# EasyEDA Pro project PR.eprj, board 新大符2.0（下单PCB） (continued)
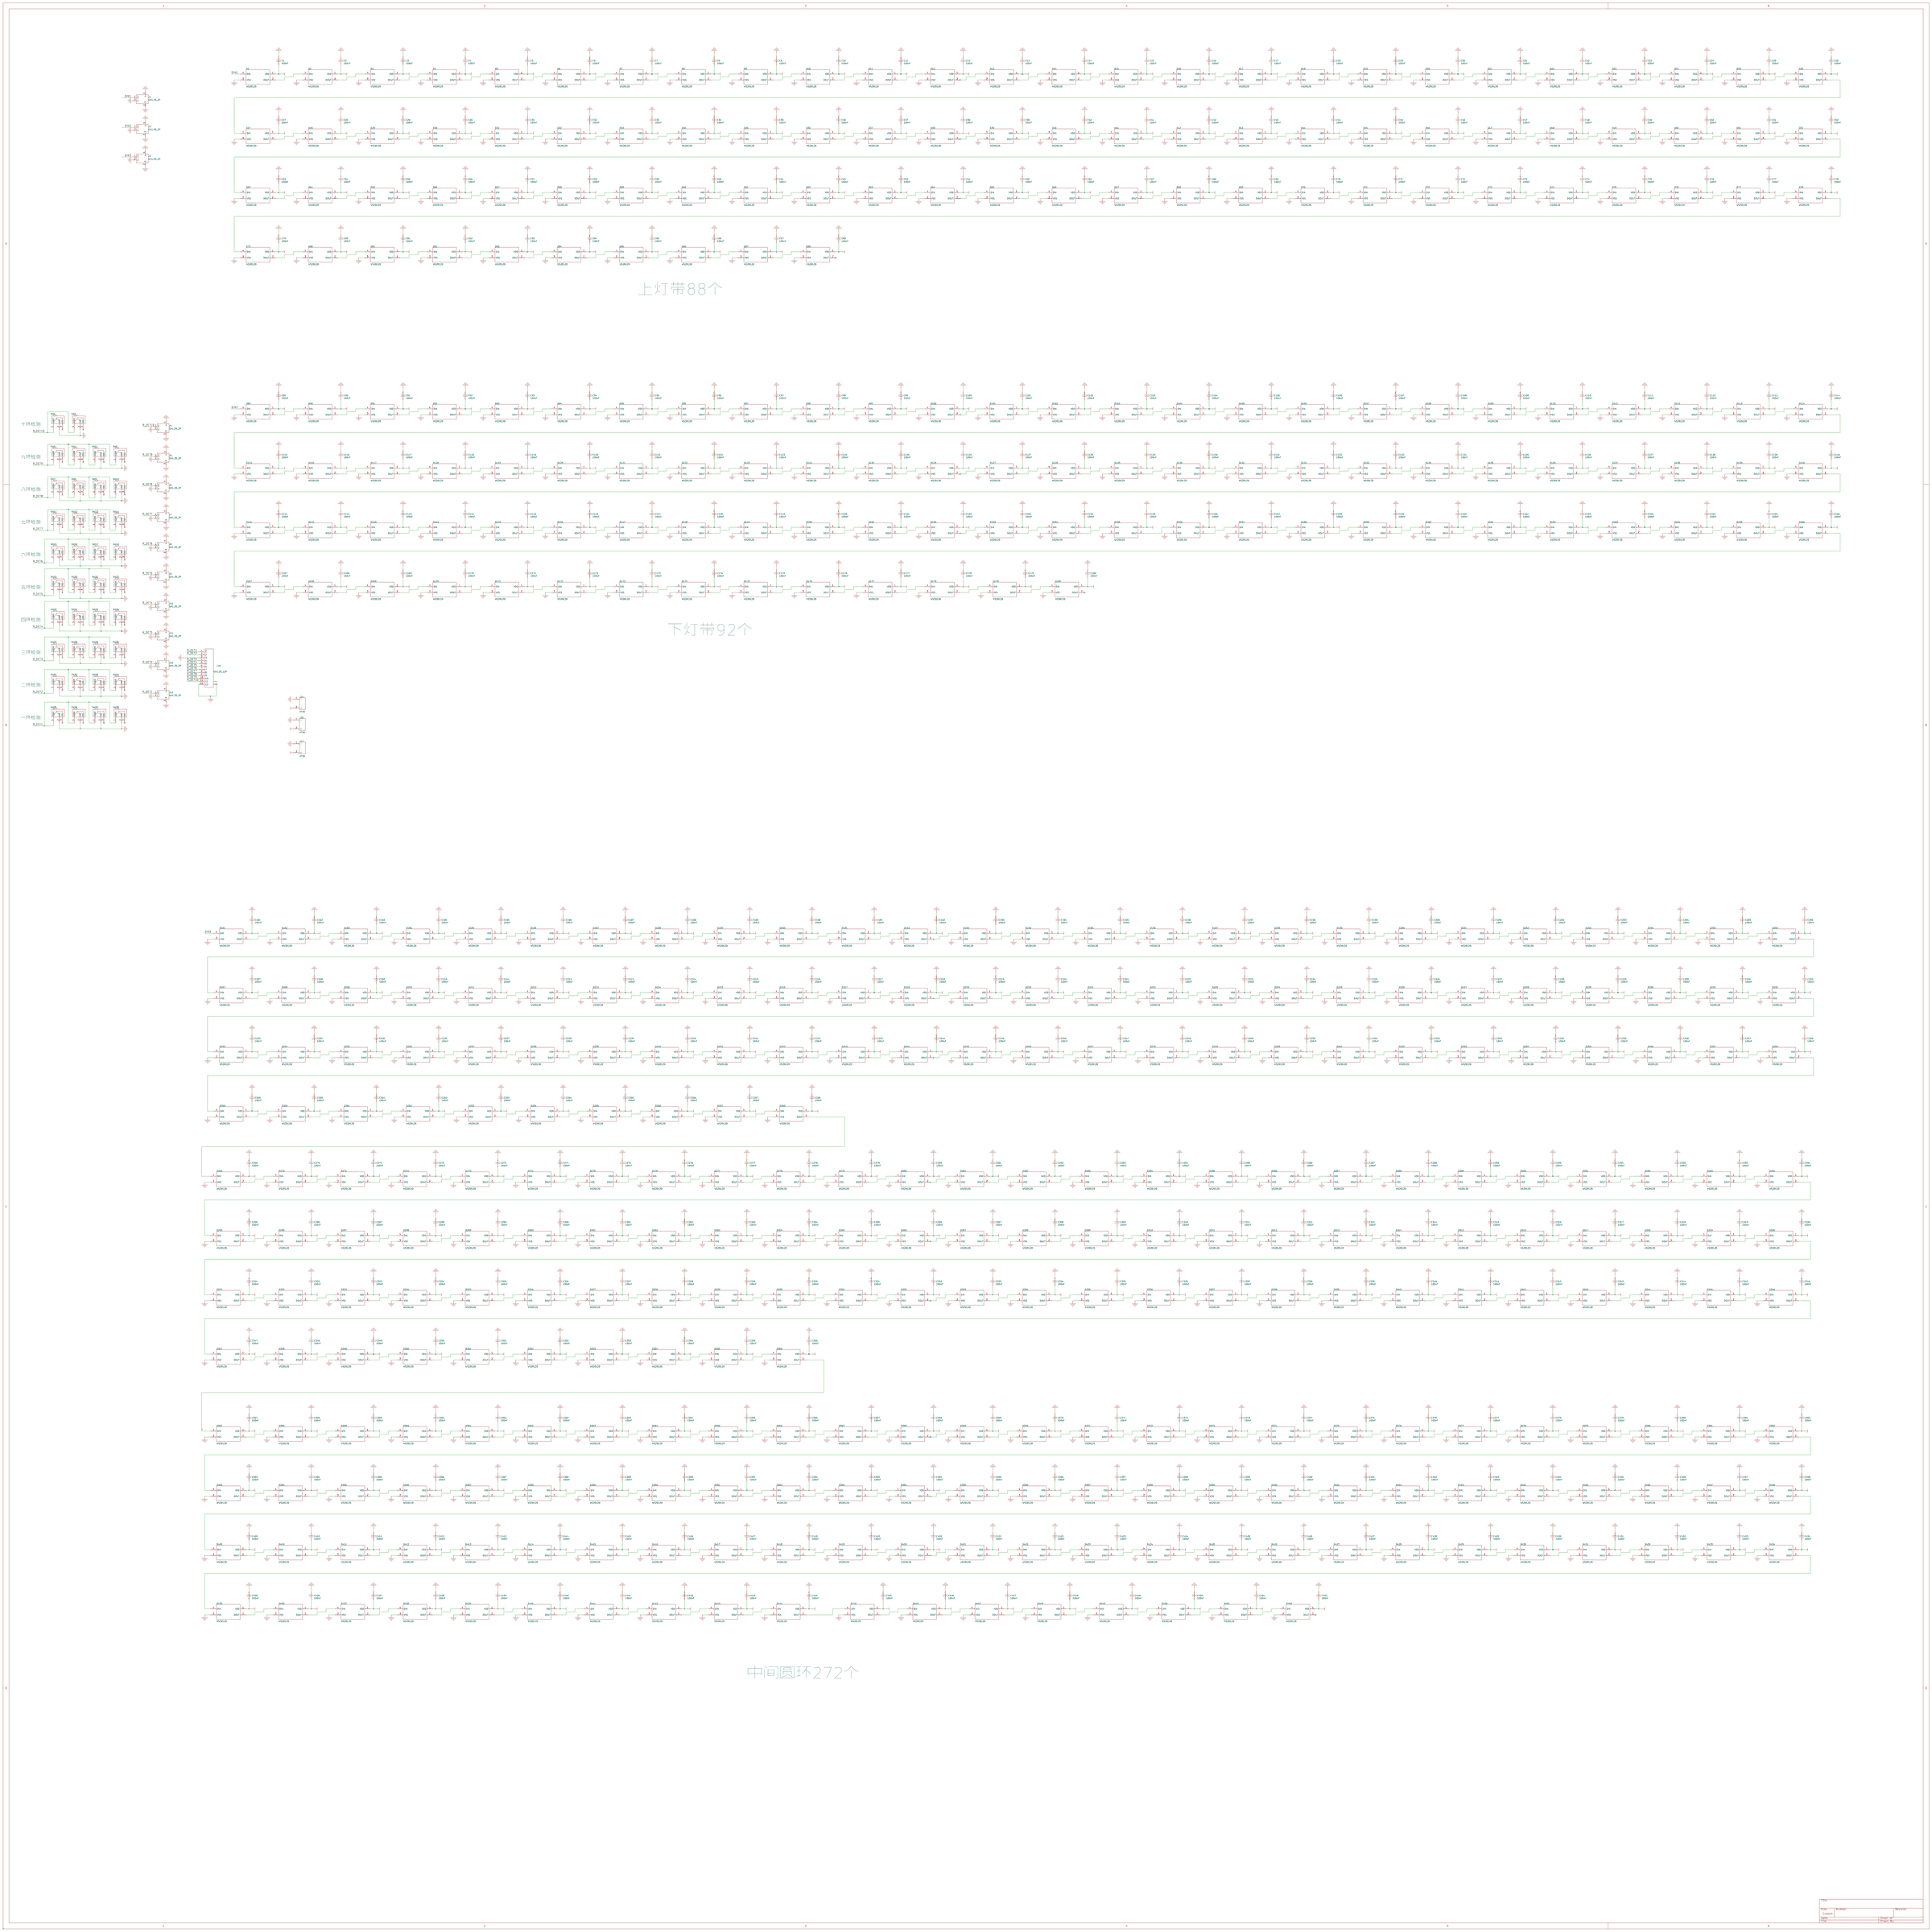
[diagram p0: schematic sheet]
## Routing (per net, layer and track width the routed paths; a pad name or vN(x,y) marks a point on that pad's centre or on a via; arc(x,y) is an arc through that point) (continued)
  Top Layer w1.27: C379.1 264.06,225.34 v3(263.74,225.07) ; 35.58,97.13 36.92,97.72 v3(37.21,97.85) ; C250.1 62.25,140.51 v3(63.88,141.26) ; C255.1 55.04,213 55.18,212.99 v3(55.37,212.98) ; v3(129.88,91.4) 129.72,91.12 128.9,89.63 128.78,89.41 ; v3(216.15,125.91) C386.1 ; D442.1 171.47,171.27 ; 171.47,171.27 171.65,171.45 v3(171.7,171.45) ; 171.47,171.27 170.09,169.89 170.09,169.89 ; v3(85.22,344.81) 85.28,344.68 C76.1 ; C246.1 v3(109.23,85.13) ; v3(167.89,231.14) 167.79,231.11 167.28,230.97 165.77,230.56 ; v3(46.16,331.58) 46.69,331.05 47.45,330.29 ; C443.1 191.6,177.8 v3(189.23,177.8) 189.01,177.8 188.89,177.67 ; C206.1 40.3,189.74 v3(40.39,189.83) ; v3(182.75,77.18) 182.67,77.09 C286.1 ; v3(276.42,17.24) C324.1 ; v3(281.77,278.53) C270.1 ; v3(222.25,65.08) C240.1 ; C260.1 v3(98.66,291.14) ; C216.1 142.18,334.02 142.4,334.08 v3(142.62,334.14) ; v3(248.92,164.81) 250.67,164.03 250.89,163.93 ; C333.1 83.8,194.02 ; C267.1 236.41,314.41 v3(235.69,312.69) ; C340.1 139.66,282.28 139.71,282.18 v3(139.83,281.94) ; C369.1 v3(116.07,244.5) ; 287.78,136.66 287.59,136.76 v3(285.92,137.71) ; 27.36,78.17 v3(27.34,78.18) C89.1 ; 27.36,78.17 27.44,78.25 27.54,78.25 ; 27.36,78.17 27.35,78.16 ; C414.1 v3(138.66,160.71) ; v3(303.13,35.23) C132.1 ; 108.07,279.33 106.52,280.88 C301.1 ; v3(13.08,71.12) 12.95,71.04 C119.1 ; 354.25,116.96 354.38,116.91 D178.1 ; v3(64.69,324.41) C88.1 ; v3(323.4,293.07) 321.46,292.38 C8.1 ; v3(247.67,355.84) 247.16,354.56 C21.1 ; C145.1 82.48,20.26 v3(82.5,20.31) 82.51,20.36 ; C321.1 250.92,113.82 v3(249.42,115.33) ; C99.1 v3(12.71,116.13) ; v3(39.2,258.6) 39.48,258.52 41,258.08 ; v3(356.83,83.36) C140.1 ; C34.1 299.48,336.95 299.73,337.63 299.99,338.34 v3(300,338.37) ; 173.82,294.12 v3(174.11,292.23) ; v3(37.85,317.63) C44.1 ; 226.92,193.49 v3(224.92,192.97) 224.92,192.97 224.92,192.98 ; J17.2 337.9,196.81 arc(337.3,196.57) 336.89,196.07 ; v3(120.19,367.84) C52.1 ; 198.42,216.71 D446.1 v3(196.98,215.27) ; v3(82.61,110.01) 81.08,108.74 arc(80.97,108.67) C248.1 ; v3(95.05,96.64) 93.7,95.29 93.7,95.29 93.48,95.06 ; C328.1 v3(134.44,105.21) ; v3(41.38,85.04) 39.87,84.35 39.77,84.31 ; v3(158.62,184.28) 158.72,183.91 159.13,182.28 C445.1 ; C450.1 197.57,190.71 D451.1 v3(197.61,190.72) ; v3(273.89,146.02) 275.79,145.07 ; C104.1 v3(333.08,57.49) 333.01,57.49 332.92,57.4 ; C239.1 231.89,68.34 v3(231.19,70.03) ; 242.7,191.05 240.53,191.05 v3(240.5,191.01) ; 187.48,16.16 v3(187.48,18) ; v3(253.37,217.42) 253.31,217.59 253.18,218.01 C405.1 ; C3.1 v3(341.99,269.27) ; 218.95,371.06 v3(218.95,372.75) ; v3(186.05,248.25) 186.02,248.28 C421.1 ; C45.1 50.32,308.61 v3(49.84,308.95) ; C92.1 v3(25.96,135.84) ; 336.89,196.07 334.71,191.22 arc(334.27,190.69) 333.61,190.47 ; v3(106.81,229.11) 104.97,229.8 C368.1 ; 276.53,233.27 276.61,233.27 ; 143.34,68.67 143.09,68.01 v3(142.57,66.68) ; v3(164.72,321.69) 164.52,322.37 C251.1 ; C372.1 v3(156.97,275.41) ; C364.1 103.61,158.33 105.56,159.27 v3(105.79,159.39) ; 245.1,58.31 245.01,58.54 v3(244.23,60.35) ; v3(294.18,21.39) 294.71,20.09 C178.1 ; 172.49,4.48 v3(172.49,6.44) ; C91.1 7.72,130.25 v3(9.2,130.89) ; C171.1 339.99,121.92 339.78,121.99 v3(339.6,122.05) ; C341.1 152.93,291.17 v3(153.16,291.21) ; C15.1 v3(320.97,306.69) ; v3(242.16,232.01) C404.1 ; C346.1 251.24,270.19 v3(249.53,268.48) ; C391.1 v3(122.15,160.07) ; v3(195.68,61.87) C241.1 ; v3(214.87,30.67) 215.05,29.57 C126.1 ; v3(199.29,261.61) C401.1 ; 237.42,370.79 v3(237.51,370.88) C20.1 ; 159.12,15.99 v3(159.12,18) ; C399.1 160.15,260.54 160.17,260.55 v3(160.4,260.6) ; v3(109.22,364.24) 109.31,364.07 110.07,362.53 110.17,362.34 110.24,362.2 ; 67.69,176.73 v3(69.82,177.15) ; C447.1 175.29,219.66 v3(175.51,219.71) ; v3(328.93,265.43) 328.76,265.38 328.73,265.37 328.72,265.37 C4.1 ; 35.2,65.51 35.2,65.56 v3(35.15,65.61) 33.6,64.81 C118.1 ; v3(80.26,355.98) 80.32,355.86 C83.1 ; v3(297.88,171.8) 300.35,171.37 ; v3(220.29,285.58) 221.03,287.22 C344.1 ; C209.1 v3(50.53,246.15) ; v3(295.78,326.52) 295.71,326.36 C33.1 ; 312.22,233.15 v3(312.87,231.27) ; v3(255.68,38.19) 255.84,36.43 ; v3(225.04,181.36) 225.26,181.31 C427.1 ; C214.1 v3(109.09,316.47) ; 21.29,57.25 v3(23.09,58.24) ; C159.1 v3(56.03,27.85) ; C242.1 182.67,60.76 v3(182.63,60.8) ; C105.1 321.97,62.93 320.14,63.66 v3(319.91,63.75) ; v3(127,9.78) 126.94,9.59 126.89,9.43 C151.1 ; v3(162.43,63.75) 162.4,63.55 162.38,63.37 C243.1 ; C292.1 v3(89.28,126.86) ; v3(95.68,360.48) C73.1 ; v3(288.39,31.61) 289.13,29.71 C147.1 ; 97.31,15.15 v3(98.07,16.8) ; C28.1 286.27,341.3 286.78,342.79 v3(286.79,342.81) ; C417.1 131.95,210.9 132.11,210.85 v3(132.21,210.82) ; 71.91,32.8 v3(72.67,34.46) ; v3(284.27,203.55) C316.1 ; C365.1 98.99,168.74 v3(98.93,168.91) ; 303.67,347.62 v3(304.19,349.29) ; v3(204.85,178.94) 204.88,178.94 D444.1 205.08,178.77 206.52,177.33 C442.1 ; 107.93,260.18 v3(109.61,258.69) ; v3(182.75,47.21) 182.79,47.17 C194.1 ; C441.1 v3(211.78,202.06) ; v3(100,347.91) C78.1 ; C290.1 v3(118.64,99.7) ; C280.1 276.9,123.21 v3(276.73,123.32) ; v3(146.05,319.53) 145.97,319.52 C263.1 ; 316.16,205.53 313.96,205.53 v3(313.84,205.41) ; v3(235.08,105.54) 235.28,105.23 235.79,104.46 C31.1 ; C153.1 v3(90.19,42.33) 90.1,42.37 ; C144.1 231.68,21.05 231.68,21.05 v3(231.65,21.21) ; v3(186.06,278) 186.14,278.09 C374.1 ; C238.1 248.53,76.38 247.91,77.66 v3(247.83,77.83) ; 201.66,27.61 v3(201.66,29.55) ; v3(269.82,215.06) D367.1 ; C116.1 8.76,87.36 v3(10.47,88.09) ; C342.1 186.02,292.56 v3(186.05,292.52) ; 164.72,370.3 v3(164.72,372.2) ; 168.56,309.13 v3(168.89,306.99) ; C276.1 299.78,189.78 v3(299.73,189.82) ; C127.1 308.93,23.2 v3(308.53,24.18) 308.54,24.2 308.54,24.31 ; 332.32,314.6 v3(333.99,315.92) ; 164.34,348.83 v3(164.34,350.61) ; v3(248.16,322.58) C222.1 ; v3(334.7,31.71) 334.73,31.68 336.51,30.34 ; v3(248.55,11.49) C107.1 ; C14.1 v3(324.1,326.9) ; v3(217.42,168.91) 217.62,168.8 218.14,168.51 C428.1 ; 359.74,44.46 359.73,44.46 v3(357.55,45.2) ; C412.1 165.88,139.52 165.94,139.76 v3(165.99,139.95) ; C173.1 356.27,98.77 v3(354.47,99.51) ; C115.1 39.8,84.28 ; v3(294.44,287.91) 296.11,289.45 ; 115.51,165.9 114.87,167.72 v3(114.81,167.89) ; C210.1 57.02,266.44 v3(58.85,265.52) ; v3(69.11,24.17) 68.91,23.64 C113.1 ; C9.1 267.98,333.56 v3(268.63,335.03) ; v3(68.25,351.46) C82.1 ; v3(85.47,160.4) 85.54,160.15 85.54,160.13 86.05,158.28 ; v3(216.15,146.56) 216.31,146.37 C409.1 ; v3(306.44,145.32) 306.57,145.27 306.69,145.23 C233.1 ; 312.32,260.25 v3(312.36,260.28) 314.01,261.15 C227.1 ; 76.27,45.65 v3(76.27,45.83) C109.1 ; C60.1 v3(255.29,339.64) ; v3(298.71,208.05) C315.1 ; v3(164.08,246.2) 162.35,245.64 C420.1 ; C201.1 v3(66.52,108.35) ; v3(55.29,346.64) 56.01,344.81 ; C308.1 223.08,303.1 222.56,301.58 v3(222.53,301.5) ; v3(103.81,337.49) 104.01,336.94 C79.1 ; C411.1 183.3,136.53 v3(183.27,136.56) ; v3(209.55,49.62) 209.99,47.34 ; 165.18,198.98 166.51,197.65 166.53,197.65 ; v3(72.95,340.03) 73.15,339.48 C84.1 ; v3(323.65,40.82) C129.1 ; v3(219.03,237.01) C423.1 ; C402.1 216.1,254.83 v3(216.03,254.64) ; 75.51,94.97 v3(76.97,96.43) ; C137.1 v3(134.39,32.55) ; v3(193.17,164.9) 195.29,165.42 ; 316.13,345 v3(316.13,345.1) 315.61,343.77 C35.1 ; C229.1 v3(326.33,234.06) ; v3(219.65,6.83) C121.1 ; v3(327.85,172.09) 330.2,171.83 ; v3(335.42,107.26) 337.52,106.56 C174.1 ; v3(200.21,92.71) C323.1 ; C413.1 150.6,148.12 v3(150.75,148.34) ; C208.1 v3(44.45,230.25) ; v3(291.71,267.22) 292.17,267.52 292.89,268 293.79,268.59 ; v3(72.07,156.08) C294.1 ; C317.1 284.94,190.67 v3(284.9,190.63) ; C26.1 278.89,358.01 v3(278.89,358.01) ; v3(220.49,98.4) 221.43,96.37 221.5,96.37 ; C235.1 288.98,113.39 288.91,113.45 v3(288.8,113.54) ; C395.1 v3(116.98,211.42) ; C19.1 v3(233.96,360.21) ; v3(345.78,51.3) 347.26,50.82 C108.1 ; v3(47.5,71.76) 47.24,71.67 45.48,71.1 ; v3(196.75,47.36) C193.1 ; v3(106.32,107.89) 106.32,107.84 104.84,106.36 ; v3(157.86,6.6) 157.86,6.48 D131.1 157.9,6.44 C100.1 ; v3(302.79,275.74) C226.1 ; C236.1 281.22,104.68 v3(281.03,104.68) ; v3(42.29,270.76) 42.51,270.69 42.59,270.66 42.68,270.63 44.17,270.12 ; v3(26.5,262.91) 28.43,262.4 ; C46.1 v3(52.51,322.18) ; 240.15,296.16 240.01,295.89 v3(239.1,294.17) ; v3(253.72,181.71) C382.1 ; C1.1 v3(344.61,254.97) ; C326.1 168.2,92.95 v3(168.24,93.12) ; v3(24.09,250.72) 24.12,250.71 C37.1 ; v3(344.55,136.53) 344.73,136.46 344.95,136.38 346.45,135.85 C180.1 ; v3(269.11,41.02) 269.17,40.83 C167.1 ; C304.1 v3(149.73,305.76) ; v3(203.2,244.86) 203.24,244.97 203.27,245.07 203.31,245.19 203.8,246.76 C422.1 ; v3(281.59,168.24) C318.1 ; v3(328.36,208.39) C230.1 ; C283.1 235.49,86.83 v3(234.76,88.43) ; v3(190.88,231.9) 190.92,232.16 191.04,232.99 C438.1 ; v3(200.51,322.15) C265.1 ; C111.1 22.1,92.82 v3(23.74,93.49) ; C36.1 37,246.42 35.56,246.77 35.2,246.85 v3(35.05,246.89) ; v3(161.16,126.37) 161.1,126.21 161.09,126.16 C388.1 ; 191.9,348.33 v3(191.9,350.1) ; v3(132.26,371.28) C87.1 ; C187.1 290.73,95.29 v3(290.6,95.29) ; C207.1 v3(40.98,212.45) ; v3(182.75,106.52) 182.79,106.48 C358.1 ; v3(315.63,190.25) 315.67,190.29 C231.1 ; v3(221.11,80.32) C284.1 ; 313.55,314.87 v3(314.83,316.36) ; v3(213.56,334.15) C220.1 ; C371.1 v3(142.97,267.39) ; v3(258.52,26.13) 258.6,25.51 258.75,24.36 ; v3(268.35,173.44) 268.6,173.38 270.35,172.96 C352.1 ; v3(240.56,149.77) C384.1 ; v3(136.32,359.97) C77.1 ; v3(158.37,29.43) 158.36,29.3 C165.1 ; v3(278.31,302.56) 278.31,302.77 279.67,304.13 ; v3(301.1,251.56) 301.48,251.77 302.26,252.19 303.02,252.6 ; C288.1 145.33,81.65 v3(146.03,83.57) ; C297.1 v3(70.67,213.27) ; C7.1 v3(337.62,298.15) ; C23.1 251.22,365.49 v3(251.74,366.82) ; C360.1 v3(155.03,113.12) ; v3(251.95,304.38) 252.96,306.15 ; v3(312.42,334.52) 312.31,334.25 C11.1 ; 182.67,89.8 182.67,91.82 v3(182.75,91.91) ; v3(119.7,115.58) 118.26,114.13 C329.1 ; v3(117.27,340.92) C72.1 ; v3(129.79,171.32) 129.84,171.16 C415.1 ; C12.1 v3(308.38,324.14) ; C131.1 298.13,45.3 v3(297.74,46.28) 297.75,46.29 297.75,46.41 ; v3(273.85,28.92) C168.1 ; v3(227.79,248.17) 229.25,250.03 ; C95.1 112.3,11.65 v3(113.02,13.59) ; v3(224.4,267.11) C376.1 ; 177.93,370.68 v3(177.93,372.33) ; v3(329.47,190.5) 331.59,190.39 331.6,190.39 333.6,190.47 ; v3(275.16,79.37) 276.71,77.44 ; 119.88,59.93 119.96,60.1 v3(120.9,62.09) ; C157.1 v3(39.61,48.39) ; v3(145.42,134.37) 144.99,133.68 C389.1 ; v3(262.13,14.22) 262.15,14.11 C146.1 ; C419.1 v3(152.96,238.4) ; C431.1 170.9,152.84 v3(171.54,154.39) ; 241.86,342.66 242.36,344.02 ; C387.1 v3(178.24,122.44) ; v3(186.05,337.6) 186.14,337.69 C218.1 ; C136.1 v3(130.77,20.74) ; v3(55.46,193.93) 55.42,193.89 C254.1 ; v3(245.73,23.59) 246.05,21.57 ; v3(82.64,247.36) 80.87,248.18 80.64,248.29 ; v3(48.35,297.97) C170.1 ; v3(242.08,35.91) C103.1 ; v3(355.69,65.51) C141.1 ; 192.02,370.68 v3(192.02,372.58) ; 54.33,123.17 v3(56.52,124.28) ; v3(211.45,109.15) C357.1 ; v3(129.76,258.83) 129.76,258.92 C370.1 ; C396.1 123.86,227.58 123.89,227.56 v3(124.08,227.46) ; v3(238.36,125.39) 239.91,123.84 C355.1 ; C25.1 v3(273.58,346.75) ; C62.1 164.76,361.69 ; v3(267.9,249.64) C347.1 ; v3(310.72,123.21) C185.1 ; C361.1 140.09,118.86 140.26,119.23 v3(140.33,119.38) ; 173.3,15.96 v3(173.3,18) ; 354.25,116.89 v3(354.2,116.84) 354.31,116.8 C172.1 ; C366.1 v3(98.64,194.06) ; C249.1 71.08,124.27 v3(72.16,124.98) ; v3(41.84,150.62) 42.24,148.5 ; C179.1 v3(282.88,43.36) 282.88,43.22 ; 223.32,212.31 v3(223.84,210.44) ; v3(46.31,283.62) 46.59,283.54 47.99,283.13 48.25,283.05 ; C123.1 v3(60.1,38.65) ; v3(113.03,352.04) 113.08,351.92 C75.1 ; v3(186.36,151.89) C430.1 ; v3(205.27,275.38) 206.08,277.38 C375.1 ; C416.1 128.78,193.76 128.82,193.8 129.03,193.8 v3(129.03,193.8) ; 121.07,33.26 v3(121.82,35.35) ; C258.1 v3(74.73,263.67) ; v3(254.89,241.81) 255.08,241.99 C378.1 ; v3(91.11,333.68) C71.1 ; v3(39.5,339.6) C48.1 ; C418.1 140.62,226.34 140.7,226.29 v3(140.84,226.19) ; v3(288.38,242.53) 290.23,243.36 C313.1 ; 98.16,247.45 v3(99.93,246.35) ; v3(31.84,288.95) 32.44,288.78 33.63,288.43 ; C135.1 v3(143.92,18.84) ; v3(318.41,137.14) 320.39,136.34 C184.1 ; 173.12,27.62 v3(173.12,29.55) ; v3(234.51,9.24) 234.88,7.22 ; v3(114.43,143.64) 114.28,143.53 114.28,143.53 C363.1 ; v3(114.55,194.06) 114.55,194.05 D381.1 114.31,194.02 C394.1 ; 219.01,320.6 218.94,320.36 218.49,318.84 v3(218.43,318.65) ; C410.1 207.19,138.68 v3(205.36,138.11) ; 191.9,359.76 v3(191.9,361.53) ; 140.24,5.49 v3(140.99,7.28) ; v3(228.48,33.11) C176.1 ; v3(266.89,293.89) C269.1 ; C259.1 85.47,278.47 v3(85.73,278.24) ; C18.1 v3(229.79,347.93) ; C101.1 v3(28.88,123.77) ; C217.1 163.82,337.23 163.93,336.55 164,336.09 v3(164.11,335.42) ; v3(146.69,206.88) 146.55,206.93 C435.1 ; 177.42,348.32 v3(177.42,349.98) ; v3(262.5,156.46) C353.1 ; C198.1 103.72,69.1 v3(105.09,71.08) ; 145.74,172.49 145.51,173.28 145.24,174.22 145.23,174.25 145.22,174.3 v3(145.16,174.5) ; C215.1 v3(124.41,323.71) ; v3(70.1,194.06) 70.07,194.06 D276.1 69.9,194.14 C296.1 ; C152.1 v3(102.39,27.6) ; v3(179.83,206.63) 179.8,206.59 C449.1 ; 128.07,147.69 129.35,148.97 v3(129.54,148.97) ; C425.1 v3(238.7,212.72) ; v3(226.31,51.24) C191.1 ; C257.1 v3(65.86,247.71) ; v3(206.58,226.07) 206.64,226.18 C439.1 ; C6.1 v3(326.57,280.24) ; v3(132.57,238.21) 131.27,239.51 C397.1 ; 148.94,370.62 v3(148.94,372.19) ; C264.1 186.14,323.54 v3(186.18,323.51) ; C22.1 v3(260.25,351.32) ; C96.1 v3(12.63,103.07) ; v3(199.92,336.22) C219.1 ; v3(263.75,313.45) C223.1 ; 176.11,280 v3(176.26,277.94) ; C138.1 30.01,110.15 v3(31.68,110.81) ; v3(343.78,87.78) C393.1 ; C300.1 v3(92.47,262.58) ; v3(118.75,287.4) 118.64,287.55 118.61,287.61 C302.1 ; C273.1 308.68,238.34 307.44,237.83 arc(307.29,237.76) v3(307.16,237.67) ; C398.1 v3(148.37,252.39) ; C351.1 270.58,190.79 v3(270.55,190.75) ; C2.1 v3(332.54,250.39) ; v3(203.06,290.58) C343.1 ; 186.89,27.64 v3(186.89,29.55) ; v3(227.71,137.13) 228.96,135.6 ; C253.1 v3(54.49,176.45) ; v3(340.95,72.74) C143.1 ; v3(260.27,68.93) C189.1 ; v3(302,107.97) C186.1 ; C330.1 v3(107.05,128.41) ; C350.1 v3(282.52,223.39) ; v3(151.67,98.3) 151.08,96.71 C327.1 ; C5.1 v3(339.33,283.87) ; C29.1 v3(291.54,353.68) ; C339.1 v3(124.33,272.67) ; v3(60.37,335.59) C86.1 ; 133.35,298.71 v3(134.28,296.63) ; C199.1 v3(90.52,81.97) ; 146.84,27.97 v3(147.6,29.52) ; C213.1 v3(94.32,306.09) ; 201.66,16.05 v3(201.66,18) ; C245.1 124.06,74 v3(124.87,75.71) ; C367.1 v3(100.96,212.13) ; 28.97,276.34 v3(29.08,276.35) 29.28,276.28 C43.1 ; C298.1 v3(75.31,230.78) ; C158.1 v3(50.78,58.49) ; v3(159.89,160.66) 159.78,160.66 D428.1 158.37,159.25 C432.1 ; v3(312.73,50.63) C93.1 ; v3(229.02,158.46) C408.1 ; 218.82,348.58 v3(218.82,350.48) ; C262.1 v3(129.57,310.9) ; v3(186.31,308.14) 186.27,308.18 C306.1 ; 240.03,260.04 240.03,259.98 v3(238.7,258.65) ; v3(311.91,162.69) C232.1 ; 187.07,4.4 v3(187.07,6.44) ; 205.11,370.93 v3(205.11,372.75) ; v3(279.27,258.2) C312.1 ; 83.04,176.86 v3(85.28,177.25) ; C331.1 v3(96.89,143.29) ; 219.33,360.77 v3(219.33,362.68) ; C156.1 v3(28.43,38.3) ; C234.1 300.19,128.03 v3(298.82,128.69) ; 205.11,359.88 v3(205.11,361.66) ; v3(51.26,137.33) C203.1 ; v3(254.33,284.34) C310.1 ; v3(217.62,18.75) C122.1 ; D294.1 293.45,154.23 293.73,154.16 295.16,153.7 C278.1 ; C24.1 264.71,362.62 264.72,362.65 v3(264.8,362.84) ; v3(91.82,230.25) 91.66,230.33 91.63,230.34 C336.1 ; v3(35.19,303.22) C49.1 ; C196.1 v3(140.65,55.43) ; C335.1 v3(86.34,213.13) ; v3(319.83,243.68) C228.1 ; v3(124.71,356.62) 124.77,356.49 C53.1 ; C261.1 v3(113.25,302.11) ; 270.67,112.18 269.02,113.82 269.02,113.88 v3(268.86,114.05) ; v3(194.61,123.01) C349.1 ; v3(139.88,348.92) C169.1 ; v3(144.4,194.56) 144.06,194.56 D426.1 144.02,194.53 142.11,194.53 ; C27.1 v3(281.69,330.71) ; C285.1 200.07,77.97 200.05,78.07 v3(200.02,78.23) ; v3(226.19,117.86) 226.3,117.65 226.34,117.59 226.39,117.5 227.24,115.99 C356.1 ; v3(263.4,130.68) 263.4,130.68 263.55,130.58 265.38,129.41 ; v3(231.12,329.38) 231.15,329.46 231.67,330.82 C221.1 ; C110.1 10.53,50.5 v3(10.79,50.67) ; C293.1 v3(80.18,142.53) ; 151.22,349.54 v3(151.22,350.98) ; C407.1 239.15,173.26 237.38,173.81 v3(237.34,173.83) ; C362.1 v3(128.58,128.57) ; v3(326.22,78.56) 328.24,77.82 ; C436.1 151,218.03 D439.1 152.4,216.67 v3(152.53,216.54) ; C205.1 v3(40.47,176.14) ; v3(253.4,199.24) C381.1 ; v3(201.93,152.33) C429.1 ; C183.1 326.19,153.79 324.42,154.21 v3(324.19,154.27) ; C112.1 v3(63.14,48.05) 63.05,48.08 ; C400.1 v3(186.02,262.14) ; v3(263.07,87.65) C237.1 ; C287.1 v3(163.54,78.92) ; C149.1 86.76,29.68 86.89,29.96 v3(86.93,30.05) 86.96,30.13 ; C256.1 v3(59.82,230.61) ; v3(330.53,93.07) C139.1 ; 171.24,193.8 C452.1 ; 150.08,359.77 v3(150.08,361.52) ; v3(253.25,141.07) C354.1 ; 272.89,269.4 271.32,267.83 271.16,267.83 v3(271.14,267.84) ; C212.1 v3(78.08,290.41) ; v3(276.61,233.17) C348.1 ; v3(129.08,345.88) C50.1 ; v3(230.65,224.1) C424.1 ; v3(76.63,329.11) C81.1 ; C359.1 v3(168.79,108.73) ; C195.1 v3(159.34,49.97) ; v3(205.09,306.2) 205.44,308.22 ; C90.1 v3(117.37,23.79) ; 205.62,348.58 v3(205.62,350.45) ; 177.67,359.5 D44.1 ; C150.1 v3(106.23,40.37) ; D140.1 v3(201.66,5.53) 201.66,4.62 ; C10.1 v3(332.36,336.68) ; v3(356.19,132.99) C175.1 ; v3(56.32,153.8) C252.1 ; v3(236.41,277.61) C345.1 ; C314.1 v3(296.87,227.33) ; v3(251.69,98.27) C282.1 ; C211.1 v3(68.97,278.62)
  vias: v3(83.91,193.93) v3(108.15,279.25) v3(164.82,360.76) v3(165.09,199.05) v3(171.23,193.8) v3(177.61,360.44) v3(293.44,154.19)
DIN1: length 17.4
  Bottom Layer w0.381: J1.1 27.17,237.46 v1(19.43,252.35)
DIN2: length 14.7
  Bottom Layer w0.381: J2.1 28.64,151.46 v1(30.61,137.54)
DIN3: length 7.7
  Bottom Layer w0.381: v2(40.39,194.69) 33.5,193.27 J3.1
I: length 13.6
  Top Layer w0.381: D356.2 143.8,117.85 156.07,117.34 D357.4
NETD1_2: length 8.2
  Top Layer w0.254: 30.62,248.61 30.62,249 arc(30.43,249.97) 29.88,250.79 27.59,253.08 arc(26.77,253.63) 25.79,253.82 D1.2
NETD2_2: length 20.5
  Top Layer w0.254: D3.4 36.29,250.2 arc(36.34,250.13) D2.2
NETD3_2: length 9.2
  Top Layer w0.254: D4.4 29.6,265.27 arc(28.78,265.82) 27.8,266.02 D3.2
NETD4_2: length 23
  Top Layer w0.254: 40.18,261.7 D4.2 arc(40.24,262.14) 39.99,262.51 D5.4
NETD5_2: length 10.6
  Top Layer w0.254: D6.4 31.19,279.05 arc(30.74,279.35) D5.2
NETD6_2: length 23.6
  Top Layer w0.254: D6.2 27.56,289.84 arc(27.32,290.2) D7.4
NETD7_2: length 11.4
  Top Layer w0.254: D8.4 35.7,291.31 arc(34.87,291.86) 33.9,292.05 D7.2
NETD8_2: length 25.1
  Top Layer w0.254: D9.4 46.7,288.79 arc(47.25,287.96) 47.44,286.99 D8.2
NETD9_2: length 10.1
  Top Layer w0.254: D10.4 37.58,305.8 arc(37,306.19) D9.2
NETD10_2: length 26
  Top Layer w0.254: D11.4 34.09,317.5 arc(34.29,316.53) 34.84,315.71 D10.2
NETD11_2: length 10.5
  Top Layer w0.254: 39.97,320.16 45.34,314.78 arc(45.89,313.96) 46.08,312.99 D12.4
NETD12_2: length 35.5
  Top Layer w0.381: D12.2 51.73,312.07 36.47,342.72 D13.4
NETD13_2: length 7.2
  Top Layer w0.381: 42.02,341.72 43.07,340.67 arc(43.62,339.85) 43.81,338.88 43.81,337.19 arc(43.62,336.22) 43.07,335.4 D14.4
NETD14_2: length 8.7
  Top Layer w0.381: D15.4 49.67,326.25 arc(50.23,327.08) 50.42,328.05 50.42,330.92 arc(50.23,331.89) 49.67,332.71 D14.2
NETD15_2: length 27
  Top Layer w0.381: D15.2 54.91,324.93 53.52,350.61 D16.4
NETD16_2: length 7.6
  Top Layer w0.508: 58.7,340.19 58.76,340.74 58.66,345.08 arc(58.65,345.11) 58.65,345.14 58.33,347.22 D16.2
NETD17_2: length 8.3
  Top Layer w0.381: 63.02,329.02 63.52,329.52 arc(64.07,330.34) 64.26,331.31 64.26,334.88 arc(64.07,335.85) 63.52,336.67 D17.2
NETD18_2: length 30.6
  Top Layer w0.254: D18.2 67.93,326.25 66.44,355.36 D19.4
NETD19_2: length 8.8
  Top Layer w0.381: D19.2 71.9,352.04 arc(72.45,351.22) 72.64,350.25 72.64,347.06 arc(72.45,346.09) 71.9,345.27 D20.4
NETD20_2: length 8.4
  Top Layer w0.381: D20.2 76.22,340.99 arc(76.77,340.17) 76.96,339.2 76.96,336.78 arc(76.77,335.8) 76.22,334.98 D21.4
NETD21_2: length 30.3
  Top Layer w0.381: D21.2 79.83,330.87 78.66,359.88 78.76,360.51
NETD22_2: length 8.2
  Top Layer w0.381: D22.2 83.73,356.85 arc(84.27,356.05) 84.45,355.09 84.45,351.12 arc(84.26,350.15) 83.72,349.34
NETD23_2: length 7.9
  Top Layer w0.381: D24.4 89.43,343.87 arc(89.24,344.84) 88.69,345.67 D23.2
NETD24_2: length 30.3
  Top Layer w0.381: D24.2 94.31,335.44 93.91,364.45 94,365.09
NETD25_2: length 9.8
  Top Layer w0.381: D26.4 98.95,353.14 arc(99.5,353.96) 99.69,354.94 99.69,359.64 arc(99.5,360.62) 98.95,361.44 D25.2
NETD26_2: length 7.5
  Top Layer w0.381: D27.4 arc(102.31,342.98) 102.81,343.73 102.89,343.81 arc(103.44,344.63) 103.63,345.6 103.63,347.75 arc(103.49,348.45) D26.2
NETD27_2: length 30.1
  Top Layer w0.381: 107.75,368.73 107.65,368.1 107.01,339.25 D27.2
NETD28_2: length 9.5
  Top Layer w0.381: D29.4 112.54,357.59 arc(113.09,358.41) 113.28,359.38 113.28,363.44 arc(113.09,364.41) 112.54,365.23 D28.2
NETD29_2: length 8.2
  Top Layer w0.381: D29.2 116.35,353.06 arc(116.9,352.23) 117.09,351.26 117.09,348.78 arc(116.9,347.81) 116.35,346.98 116.09,346.72 arc(115.72,346.17) D30.4
NETD30_2: length 30.5
  Top Layer w0.381: 120.37,342.05 120.47,342.68 118.42,371.82 D31.4
NETD31_2: length 8.6
  Top Layer w0.381: 123.29,368.98 123.72,368.55 arc(124.27,367.73) 124.46,366.76 124.46,363.45 arc(124.27,362.47) 123.72,361.65 D32.4
NETD32_2: length 7.9
  Top Layer w0.254: D32.2 128.45,357.18 arc(128.79,356.49) 128.91,355.73 128.91,353.48 arc(128.71,352.51) 128.16,351.68 127.72,351.24 arc(127.49,350.89) D33.4
NETD33_2: length 29
  Top Layer w0.254: D34.4 130.44,375.17 132.32,347.72 D33.2
NETD34_2: length 8.7
  Top Layer w0.381: 136.53,369.58 136.53,368.59 arc(136.33,367.62) 135.78,366.79 135.39,366.4 arc(134.84,365.58) 134.64,364.61 134.64,364.58 ; D34.2 135.75,371.95 arc(136.33,370.83) 136.53,369.59
NETD35_2: length 8.4
  Top Layer w0.381: D36.4 138.2,353.68 arc(138.39,354.66) 138.94,355.48 139.67,356.2 arc(140.07,356.8) 140.21,357.5 140.21,358.82 arc(140.02,359.83) 139.49,360.7 arc(139.4,360.89) 139.42,361.1 ; 139.42,361.1 D35.2
NETD36_2: length 27.6
  Top Layer w0.381: D37.4 148.25,376.49 143.08,350.68 D36.2
NETD37_2: length 7
  Top Layer w0.381: D38.4 151.48,368.23 arc(152.03,369.06) 152.23,370.03 D37.2
NETD38_2: length 7.1
  Top Layer w0.381: D38.2 153.37,359.14 arc(153.18,358.17) 152.62,357.35 151.38,356.11 arc(151.11,355.93) 150.8,355.87
NETD39_2: length 27.8
  Top Layer w0.254: 154.51,351.27 154.83,351.92 164.95,377.01
NETD40_2: length 6.8
  Top Layer w0.381: D40.2 168.02,371.04 arc(167.83,370.07) 167.28,369.24 D41.4
NETD41_2: length 7.7
  Top Layer w0.381: D41.2 168.02,360.21 arc(167.83,359.24) 167.28,358.41 164.4,355.54 arc(164.37,355.52) D42.4
NETD42_2: length 28.5
  Top Layer w0.381: D43.4 177.62,376.67 167.95,351.17 D42.2
NETD43_2: length 7.7
  Top Layer w0.381: D43.2 181.23,370.37 arc(181.03,369.4) 180.48,368.57 178.39,366.47 arc(178.06,366.25) D44.4
NETD44_2: length 7.8
  Top Layer w0.381: 177.42,354.88 180.23,357.69 arc(180.78,358.51) 180.97,359.48 D44.2
NETD45_2: length 29.7
  Top Layer w0.381: D46.4 191.72,376.92 181.03,350.53 D45.2
NETD46_2: length 7.5
  Top Layer w0.381: D46.2 195.32,370.91 arc(195.13,369.94) 194.58,369.12 D47.4
NETD47_2: length 7.8
  Top Layer w0.381: D47.2 195.2,359.35 arc(195,358.38) 194.45,357.56 D48.4
NETD48_2: length 29.3
  Top Layer w0.381: D48.2 195.51,350.66 204.8,377.09 D49.4
NETD49_2: length 7.4
  Top Layer w0.381: 208.4,372.75 208.4,370.91 arc(208.21,369.94) 207.66,369.11 D50.4
NETD50_2: length 7.4
  Top Layer w0.381: D50.2 208.41,359.19 arc(208.21,358.22) 207.66,357.39 D51.4
NETD51_2: length 29
  Top Layer w0.381: D51.2 209.22,351.01 218.64,377.09 D52.4
NETD52_2: length 6.3
  Top Layer w0.381: D52.2 222.25,371.55 arc(222.05,370.57) 221.5,369.75 D53.4
NETD53_2: length 8.8
  Top Layer w0.381: D53.2 222.63,360.24 arc(222.44,359.27) 221.89,358.45 D54.4
NETD54_2: length 30.3
  Top Layer w0.381: D54.2 222.43,351.04 238.71,375.06 D55.4
NETD55_2: length 7.5
  Top Layer w0.381: 235.42,364.87 arc(236.39,365.06) 237.22,365.62 240.09,368.49 arc(240.48,369.07) D55.2
NETD56_2: length 8.8
  Top Layer w0.381: D57.4 236.38,357.45 arc(236.88,358.2) D56.2
NETD57_2: length 32.1
  Top Layer w0.381: 232.89,346.8 233.38,347.22 252.93,371 D58.4
NETD58_2: length 8.3
  Top Layer w0.381: D59.4 250.1,360.5 arc(251.07,360.69) 251.9,361.24 254.1,363.44 arc(254.65,364.27) 254.84,365.24 D58.2
NETD59_2: length 9.4
  Top Layer w0.381: D60.4 245.27,349.07 arc(246.25,349.26) 247.07,349.81 250.03,352.77 arc(250.58,353.6) 250.78,354.57 D59.2
NETD60_2: length 31.6
  Top Layer w0.381: D60.2 246.18,343.76 265.89,366.81 D61.4
NETD61_2: length 8.7
  Top Layer w0.381: D61.2 267.79,361.3 arc(267.6,360.33) 267.05,359.51 264.21,356.67 arc(263.39,356.12) 262.42,355.93 D62.4
NETD62_2: length 9.6
  Top Layer w0.381: D62.2 263.35,349.62 arc(263.16,348.65) 262.6,347.82 259.77,344.99 arc(258.95,344.44) 257.97,344.24 D63.4
NETD63_2: length 32.8
  Top Layer w0.381: D63.2 258.88,338.93 280.09,362.2 D64.4
NETD64_2: length 9.3
  Top Layer w0.381: D65.4 275.47,351.35 arc(275.53,351.36) 275.59,351.38 arc(278.82,352.94) 281.62,355.17 arc(281.9,355.58) 281.99,356.07 281.99,356.88
NETD65_2: length 9.7
  Top Layer w0.381: D66.4 271.56,339.67 arc(272.53,339.86) 273.36,340.41 275.94,343 arc(276.49,343.82) 276.68,344.79 D65.2
NETD66_2: length 32.5
  Top Layer w0.381: D66.2 272.21,334.36 292.73,357.87 293.21,358.29
NETD67_2: length 8.6
  Top Layer w0.381: D68.4 289.34,347.42 arc(290.31,347.61) 291.14,348.16 294.01,351.03 arc(294.48,351.73) D67.2
NETD68_2: length 10
  Top Layer w0.381: D69.4 284.48,335.31 arc(285.45,335.51) 286.27,336.06 288.47,338.25 arc(289.4,339.56) 289.86,341.1 D68.2
NETD69_2: length 32.2
  Top Layer w0.381: D70.4 305.38,353.47 285.27,330 D69.2
NETD70_2: length 8.4
  Top Layer w0.381: D70.2 307.29,347.84 arc(307.1,346.87) 306.55,346.04 304.22,343.72 arc(303.4,343.17) 302.42,342.97 D71.4
NETD71_2: length 9
  Top Layer w0.381: D71.2 303.1,336.92 arc(302.91,335.95) 302.36,335.12 299,331.77 arc(298.19,331.23) D72.4
NETD72_2: length 31
  Top Layer w0.381: D73.4 317.32,349.28 299.14,325.72 D72.2
NETD73_2: length 8.1
  Top Layer w0.381: D73.2 319.23,343.52 arc(319.04,342.55) 318.48,341.73 316.41,339.65 arc(315.59,339.1) 314.62,338.91 D74.4
NETD74_2: length 7.5
  Top Layer w0.381: D74.2 315.29,333.11 arc(315.1,332.14) 314.55,331.31 312.73,329.49 arc(311.9,328.94) 310.93,328.75 D75.4
NETD75_2: length 29.7
  Top Layer w0.381: D75.2 311.96,323.44 334.91,340.2 D76.4
NETD76_2: length 9.3
  Top Layer w0.381: D77.4 330.23,330.65 arc(331.21,330.84) 332.03,331.4 334.67,334.04 arc(334.83,334.28) D76.2
NETD77_2: length 10.5
  Top Layer w0.381: 326.63,324.78 322.71,320.85 arc(321.89,320.3) 320.91,320.11 D78.4
NETD78_2: length 21
  Top Layer w0.381: 337.75,319.07 337.12,318.95 317.96,314.47 317.36,314.24
NETD79_2: length 12.8
  Top Layer w0.381: 336.12,313.39 333.31,310.59 arc(332.49,310.04) 331.51,309.84 D80.4
NETD80_2: length 19.7
  Top Layer w0.381: D80.2 323.72,304.29 341.59,299.92 D81.4
NETD81_2: length 11.5
  Top Layer w0.381: 338.75,295.05 338.2,294.5 arc(337.37,293.94) 336.4,293.75 330.04,293.75 arc(329.07,293.94) 328.25,294.5 D82.4
NETD82_2: length 19.9
  Top Layer w0.381: 324.52,289.97 325.16,289.87 343.3,285.65 343.93,285.55
NETD83_2: length 10.4
  Top Layer w0.381: D84.4 332.57,280.53 arc(333.39,279.97) 334.36,279.78 338.41,279.78 arc(339.38,279.97) 340.21,280.53 D83.2
NETD84_2: length 19.9
  Top Layer w0.381: D85.4 345.97,271.04 328.33,277.04 D84.2
NETD85_2: length 10.7
  Top Layer w0.381: 333.33,267.06 334.34,266.05 arc(335.17,265.5) 336.14,265.3 341.21,265.3 arc(342.18,265.5) 343,266.05 343.12,266.17
NETD86_2: length 20.2
  Top Layer w0.381: D87.4 348.58,256.74 330.49,262.18 D86.2
NETD87_2: length 9.4
  Top Layer w0.381: D88.4 337.77,251.44 arc(338.6,250.89) 339.57,250.7 343.51,250.7 arc(344.49,250.89) 345.31,251.44 D87.2
NETD89_2: length 14
  Top Layer w0.381: 13.8,132.56 13.91,132.56 14.65,131.83 26.18,131.83 D89.2
NETD90_2: length 24.2
  Top Layer w0.381: D91.4 33.34,125.45 30.91,127.87 10.41,127.87 D90.2
NETD91_2: length 13.8
  Top Layer w0.381: 17.32,117.81 26.1,117.81 arc(26.43,117.83) 26.75,117.89 arc(27.03,117.99) 27.31,118.11 arc(27.62,118.31) 27.89,118.55 D91.2
NETD92_2: length 22.7
  Top Layer w0.381: D93.4 35.73,112.49 35.1,113.12 13.93,113.12 D92.2
NETD93_2: length 16.7
  Top Layer w0.381: 32.81,107.71 30.59,105.49 arc(29.77,104.94) 28.79,104.75 D94.4
NETD94_2: length 28.2
  Top Layer w0.381: D94.2 40.74,99.97 arc(41.32,99.86) 41.82,99.53
NETD95_2: length 10
  Top Layer w0.508: D96.4 28.96,95.16 35.62,94.55 arc(35.67,94.54) 35.72,94.55 37.79,94.81 D95.2
NETD96_2: length 10
  Top Layer w0.381: D97.4 23.28,89.76 arc(24.17,89.94) D96.2
NETD97_2: length 34.1
  Top Layer w0.381: D98.4 44.98,87.48 12.23,84.89 11.6,84.99
NETD98_2: length 12
  Top Layer w0.381: D99.4 40.42,80.63 arc(41.4,80.83) 42.22,81.38 D98.2
NETD99_2: length 12.5
  Top Layer w0.381: D100.4 26.14,73.52 arc(27.11,73.71) 27.93,74.26 D99.2
NETD100_2: length 37.6
  Top Layer w0.381: 51.46,74.21 50.82,74.19 15.22,68.22 D100.2 14.79,68.21
NETD101_2: length 9.7
  Top Layer w0.381: D101.2 48.77,68.8 arc(47.95,68.25) 46.98,68.06 D102.4
NETD102_2: length 10.2
  Top Layer w0.381: 36.8,62.75 35.49,61.44 arc(34.67,60.89) 33.69,60.69 27.33,60.69
NETD103_2: length 10.8
  Top Layer w0.381: D104.4 21.25,52.95 arc(22.22,53.14) 23.04,53.69 D103.2
NETD104_2: length 44.5
  Top Layer w0.381: 54.54,61.64 53.91,61.52 12.93,47.65 D104.2
NETD105_2: length 11.3
  Top Layer w0.381: 43.36,51.54 47.43,51.54 arc(48.41,51.74) 49.23,52.29 D105.2
NETD106_2: length 11.3
  Top Layer w0.381: D106.2 38.05,42.19 arc(37.23,41.64) 36.26,41.45 32.19,41.45
NETD107_2: length 38.2
  Top Layer w0.381: D108.4 64.34,52.23 31.18,35.89 D107.2
NETD108_2: length 6.4
  Top Layer w0.381: D109.4 62.52,43.25 arc(63.49,43.45) 64.32,44 65.54,45.22 arc(66.06,46) D108.2
NETD109_2: length 8.2
  Top Layer w0.381: D109.2 63.2,37.2 arc(63,36.23) 62.45,35.4 60.25,33.2 arc(59.43,32.65) 58.46,32.46 D110.4
NETD110_2: length 30.3
  Top Layer w0.381: D110.2 59.61,27.14 77.47,50.02 D111.4
NETD111_2: length 8.2
  Top Layer w0.381: D111.2 79.38,43.98 arc(79.18,43.01) 78.63,42.18 76.25,39.81 arc(75.43,39.25) 74.46,39.06 D112.4
NETD112_2: length 7.5
  Top Layer w0.381: D112.2 75.77,33.01 arc(75.58,32.03) 75.03,31.21 73.33,29.52 arc(72.51,28.97) 71.54,28.77 D113.4
NETD113_2: length 31
  Top Layer w0.381: D114.4 91.39,46.52 72.7,23.46 D113.2
